# EasyEDA Pro project ProProject_Avaota Pi A_2024-03-25.epro, board 点位 (continued)
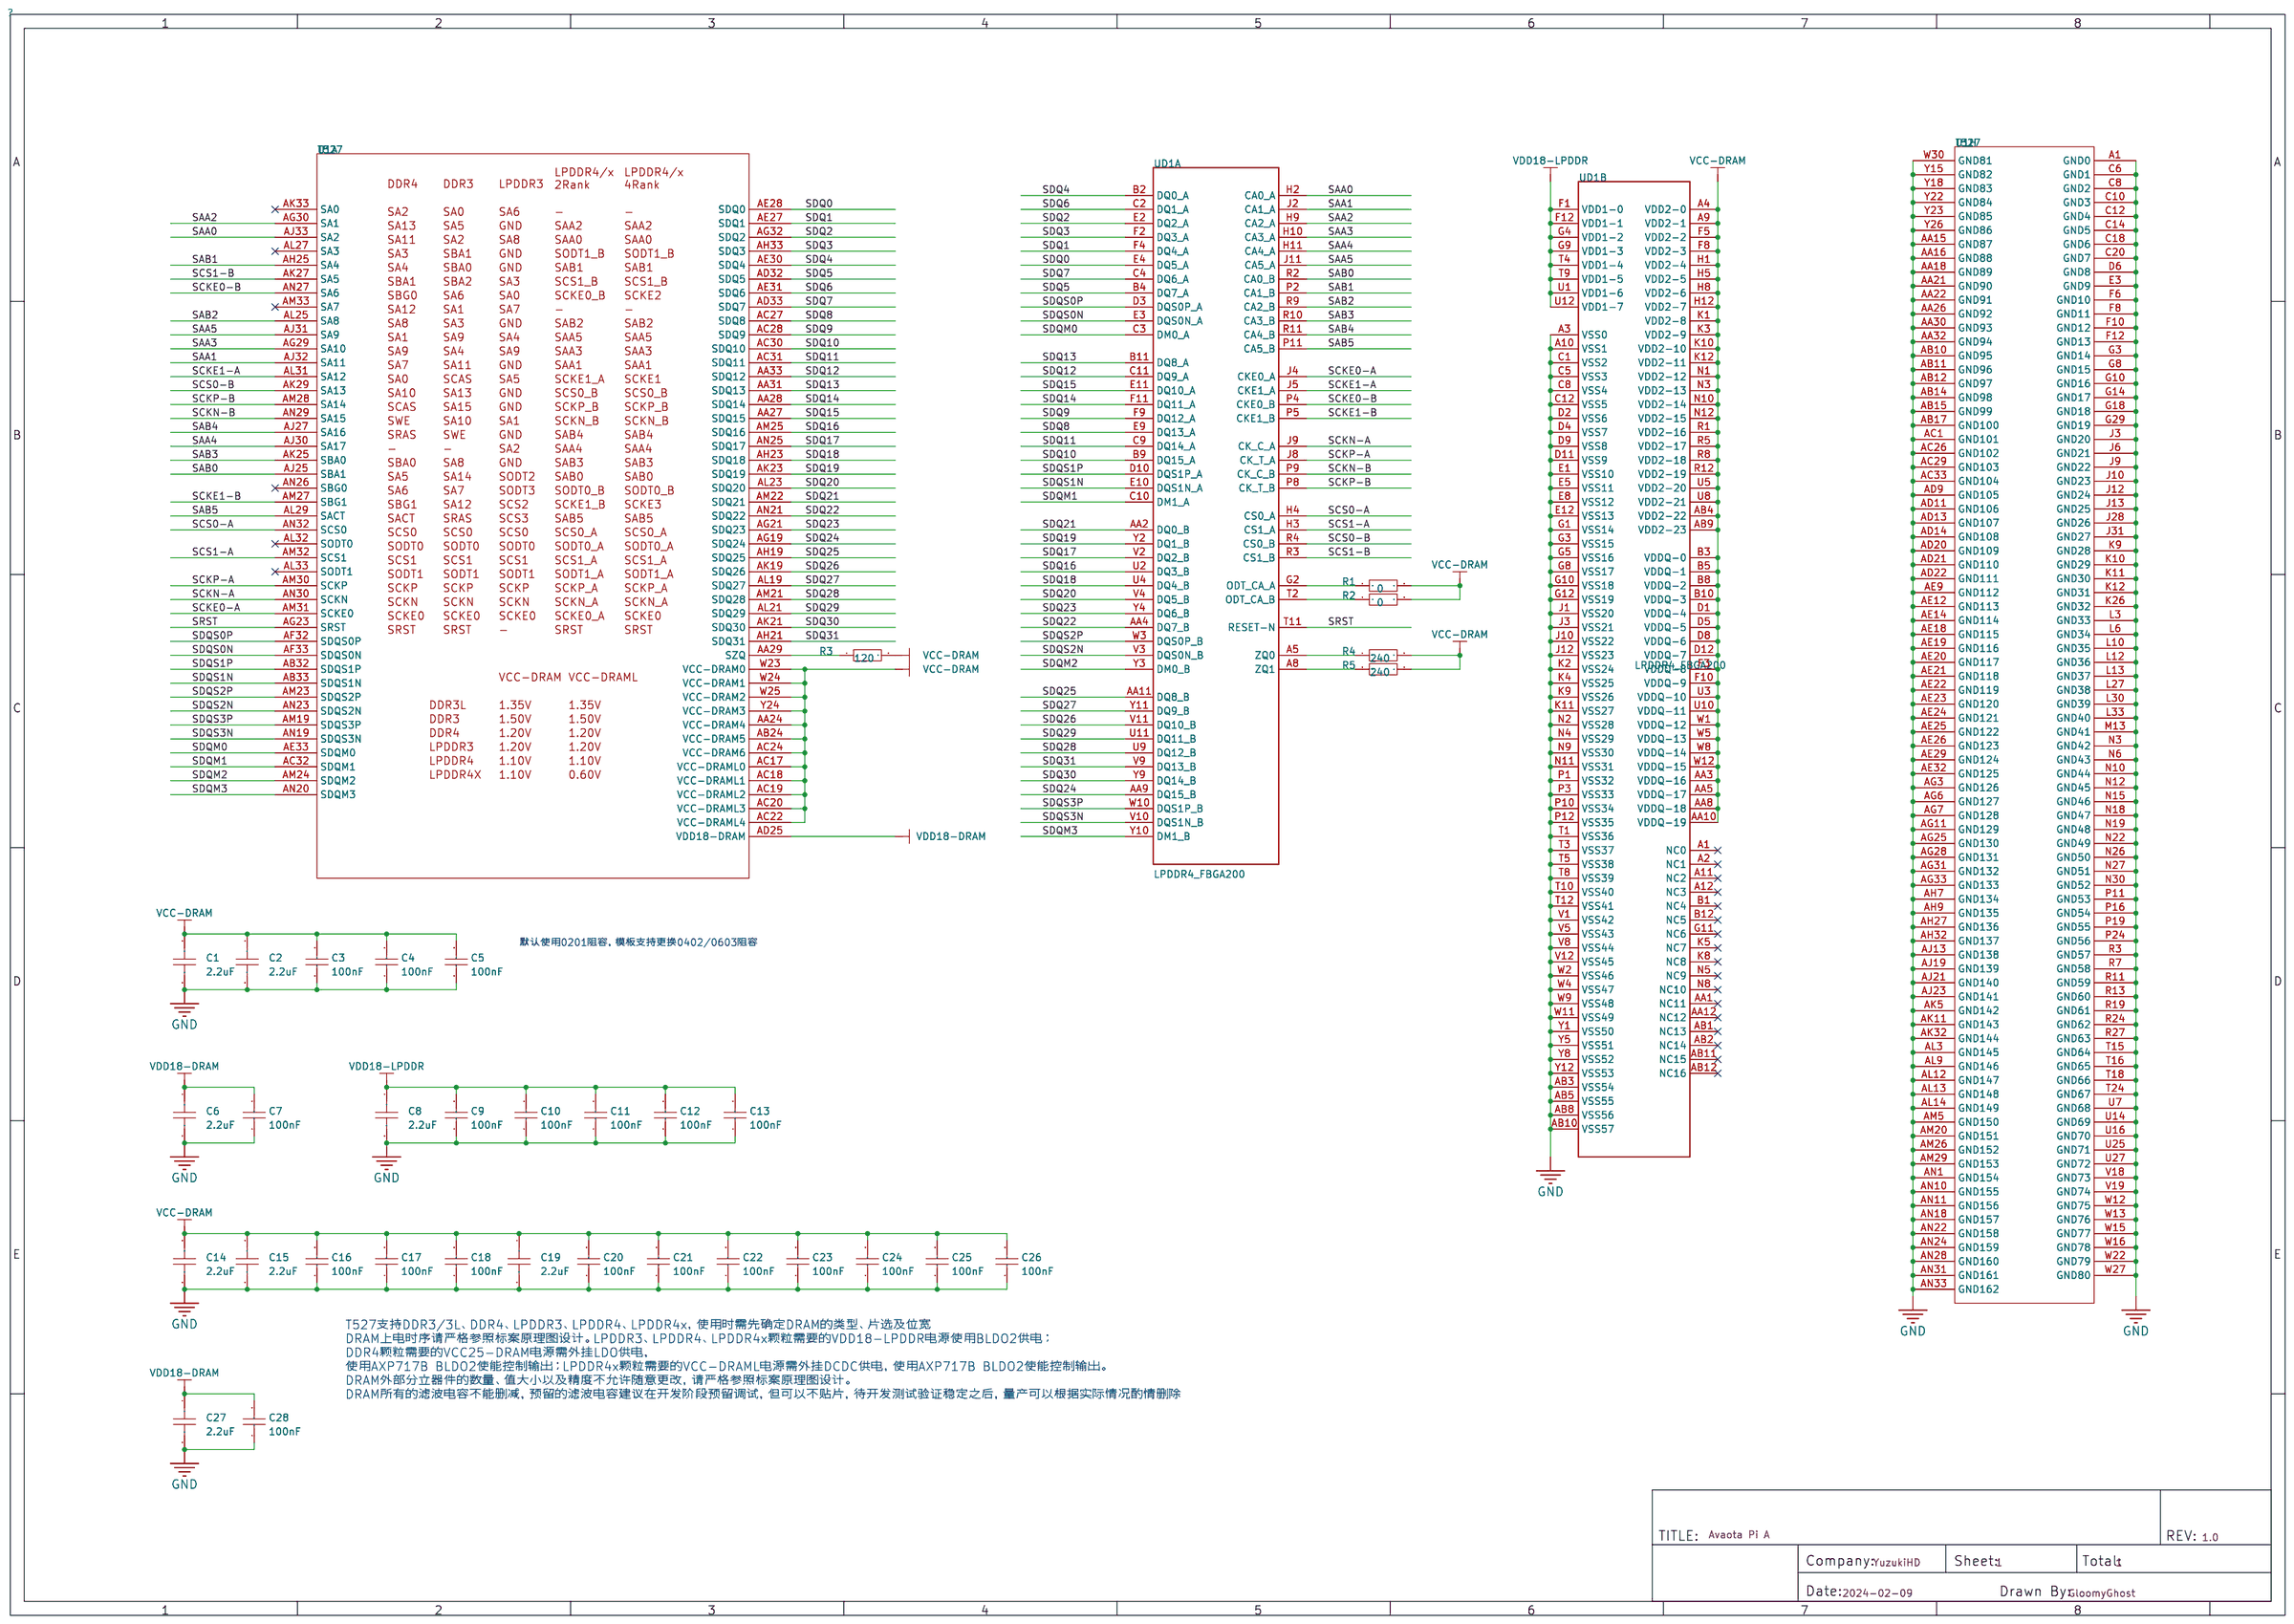
[diagram p0: schematic sheet]
## Routing (per net, layer and track width the routed paths; a pad name or vN(x,y) marks a point on that pad's centre or on a via; arc(x,y) is an arc through that point) (continued)
SDQ24: length 25.9
  Top Layer w0.102: 56.43,47.14 56.43,46.78 v2(56.54,46.68)
  Top Layer w0.115: 35.81,53.3 36.17,53.66 v2(36.17,53.7)
  Inner5 w0.115: v2(36.17,53.7) 36.24,53.77 36.6,53.77 36.88,54.05 36.88,54.46 37.41,54.99 45.37,54.99 49.38,50.99 49.38,50.83 51.51,48.69 54.2,48.69 54.51,48.39 54.51,48.37 55.23,47.65 55.78,47.65 56.54,46.89 v2(56.54,46.68)
SDQ25: length 27.2
  Top Layer w0.115: 56.01,47.07 55.93,47.14 ; v2(37.69,54.61) 37.39,54.91 35.13,54.91 34.57,54.36 34.57,53.66 34.21,53.3 ; 56.01,47.07 v2(56.01,46.68)
  Inner5 w0.115: v2(56.01,46.68) 56.01,46.79 55.52,47.27 55.01,47.27 53.87,48.41 51.13,48.41 48.96,50.58 48.96,50.81 45.68,54.09 40.73,54.09 40.36,54.46 39.04,54.46 38.81,54.23 38.07,54.23 v2(37.69,54.61)
SDQ26: length 27
  Top Layer w0.102: 54.93,47.14 54.93,46.71 v2(54.96,46.68)
  Top Layer w0.115: v2(34.57,51.71) 34.57,51.71 34.21,51.35
  Inner5 w0.115: v2(34.57,51.71) 34.21,52.07 34.21,53.19 34.44,53.42 35.05,53.42 35.18,53.29 36.58,53.29 36.96,53.67 37.79,53.67 38.02,53.9 38.96,53.9 39.09,54.03 40.31,54.03 40.66,53.67 45.39,53.67 48.54,50.52 48.54,50.41 50.84,48.11 53.59,48.11 54.96,46.73 v2(54.96,46.68)
SDQ27: length 24.4
  Top Layer w0.115: v2(34.59,53.01) 34.57,53.01 34.21,52.65 ; 54.43,47.14 v2(54.43,46.68)
  Inner5 w0.115: v2(54.43,46.68) 53.77,47.35 51.01,47.35 46.95,51.41 46.56,51.41 46.3,51.66 46.3,51.79 46,52.1 45.62,52.1 44.49,53.23 41.95,53.23 41.81,53.37 40.46,53.37 40.1,53.72 39.22,53.72 39.11,53.62 38.07,53.62 37.82,53.37 37.54,53.37 37.41,53.24 37.41,52.98 37.26,52.83 34.77,52.83 v2(34.59,53.01)
SDQ28: length 21.8
  Top Layer w0.076: 53.93,46.14 53.68,46.39 53.32,46.39 53.11,46.18 51.69,46.18 51.53,46.33 51.16,46.33
  Top Layer w0.115: 51.16,46.33 50.37,46.33 50.09,46.05 49.3,46.05 49.15,45.9 48.33,45.9 47.27,46.96 v2(47.27,47.2) ; v2(37.64,50.75) 37.03,50.75 36.75,51.03 36.29,51.03 35.97,50.7 35.81,50.7
  Inner5 w0.115: v2(37.64,50.75) 37.64,50.41 37.75,50.29 38.83,50.29 39.16,49.96 39.62,49.96 39.88,50.22 40.49,50.22 40.69,50.01 41.48,50.01 41.55,49.94 42.03,49.94 42.54,49.43 43.12,49.43 43.47,49.07 43.86,49.07 44.09,49.3 44.39,49.3 44.99,48.7 46.09,48.7 46.63,48.16 46.63,47.82 47.26,47.2 v2(47.27,47.2)
SDQ29: length 25
  Top Layer w0.115: 34.21,50.7 34.06,50.7 v2(33.8,50.95) ; 54.43,46.14 v2(54.43,45.68)
  Inner5 w0.115: v2(33.8,50.95) 34.19,50.57 34.19,49.44 34.3,49.33 36.5,49.33 36.68,49.5 38.81,49.5 39.04,49.73 39.78,49.73 40,49.96 40.36,49.96 40.59,49.73 41.25,49.73 41.43,49.56 41.91,49.56 42.45,49.01 42.95,49.01 43.3,48.65 43.93,48.65 44.3,48.29 45.57,48.29 47.14,46.71 47.78,46.71 48.19,46.29 52.18,46.29 52.59,45.88 53.76,45.88 53.96,45.68 v2(54.43,45.68)
SDQ30: length 23.2
  Top Layer w0.102: v2(54.96,45.68) 54.93,45.71 54.93,46.14 ; v2(38.48,52.55) 38.45,52.58 37.72,52.58 37.36,52.93 36.96,52.86 36.78,52.93 36.4,52.93 36.22,52.76 35.91,52.76 35.81,52.65
  Inner5 w0.115: v2(38.48,52.55) 38.96,52.55 39.04,52.48 40.23,52.48 40.49,52.73 41.22,52.73 41.4,52.55 41.4,52.22 41.65,51.97 44.29,51.97 45.81,50.44 46.72,50.44 50.51,46.66 52.25,46.66 52.65,46.25 53.74,46.25 53.95,46.05 54.59,46.05 v2(54.96,45.68)
SDQ31: length 24.9
  Top Layer w0.115: v2(37.79,52.2) 37.79,52.17 37.31,51.68 36.47,51.68 36.13,51.35 35.81,51.35 ; v2(56.01,45.68) 56.01,46.07
  Inner5 w0.115: v2(56.01,45.68) 56.01,45.77 55.5,46.28 54.23,46.28 53.49,47.02 50.75,47.02 46.81,50.95 45.89,50.95 44.04,52.81 41.78,52.81 41.53,53.06 40.18,53.06 39.85,53.39 39.29,53.39 39.01,53.11 39.01,53.02 38.9,52.91 38.28,52.91 37.79,52.43 v2(37.79,52.2)
SDQM0: length 19.5
  Top Layer w0.076: v2(56.61,39) 57.35,39.74 57.39,39.97 57.43,40.15
  Top Layer w0.115: 40.61,41.6 40.89,41.31 v2(40.89,41.27)
  内层2 w0.115: v2(56.61,39) 56.6,39 56.6,38.95 55.87,38.22 43.49,38.22 41.68,40.03 41.68,40.41 40.89,41.2 v2(40.89,41.27)
SDQM1: length 26.3
  Top Layer w0.115: 58.43,40.64 58.43,40.65 v2(57.94,41.15) ; v2(37.89,41.94) 37.77,41.81 37.01,41.81 36.9,41.91 35.63,41.91 35.32,41.6 35.01,41.6
  Inner5 w0.115: v2(37.89,41.94) 37.74,42.09 37.74,42.32 38.05,42.62 39.65,42.62 40.13,42.14 41.09,42.14 42.06,41.17 42.44,41.17 42.83,41.56 43.98,41.56 44.35,41.94 46.15,41.94 46.9,41.19 51.55,41.19 52.19,40.54 57.33,40.54 v2(57.94,41.15)
SDQM2: length 19.9
  Top Layer w0.076: 53.93,44.64 53.68,44.39 53.02,44.39 52.78,44.14 51.79,44.14
  Top Layer w0.115: v2(44.14,51.54) 44.14,52.7 43.46,53.39 42.62,53.39 42.39,53.62 42.13,53.62 41.78,53.28 41.78,53.21 41.53,52.96 41.02,52.96 40.71,52.65 40.61,52.65 ; v2(48.54,45.47) 48.54,45.18 49.75,43.97 51.46,43.97 51.64,44.14 51.79,44.14
  内层2 w0.115: v2(44.14,51.54) 44.12,51.51 44.12,50.75 44.17,50.7 44.17,50.69 46.89,47.97 46.89,47.05 47.63,46.3 47.7,46.3 v2(48.54,45.47)
SDQM3: length 23.5
  Top Layer w0.076: 53.43,46.64 53.33,46.64 53.06,46.38 51.77,46.38 51.53,46.62
  Top Layer w0.115: 51.53,46.62 50.25,46.62 49.91,46.28 49.07,46.28 48.99,46.2 48.44,46.2 47.75,46.89 47.75,47.4 47.37,47.78 v2(47.27,47.78) ; v2(34.62,52.32) 34.94,52.65 35.01,52.65
  Inner5 w0.115: v2(34.62,52.32) 35,51.94 35,51.49 35.66,50.83 37.16,50.83 37.44,51.1 38.43,51.1 38.81,50.72 39.62,50.72 39.77,50.57 40.49,50.57 40.66,50.75 41.96,50.75 42.31,50.39 42.31,50.19 42.65,49.85 44.43,49.85 45.16,49.12 46.17,49.12 47.01,48.29 47.01,48.03 v2(47.27,47.78)
SDQS0N: length 19.7
  Top Layer w0.076: 56.93,40.14 56.89,40.1 56.89,39.94 56.6,39.65 56.42,39.65 56.14,39.37 55.67,39.37 55.54,39.23 v2(55.54,39.03)
  Top Layer w0.097: v2(40.93,42.57) 40.61,42.9
  内层2 w0.127: v2(40.93,42.57) 40.75,42.57 40.63,42.45 40.63,42.18 40.8,42 41.22,42 42.53,40.68 42.53,40.43 43.23,39.73 48.33,39.73 48.54,39.52 52.09,39.52 52.26,39.69 55.03,39.69 55.54,39.18 v2(55.54,39.03)
SDQS0P: length 20.1
  Top Layer w0.076: v2(54.98,39.03) 55.5,39.55 56.06,39.55 56.34,39.83 56.49,39.83 56.69,40.03 56.69,40.26 56.93,40.5 56.93,40.64
  Top Layer w0.127: v2(40.26,42.57) 40.58,42.25 40.61,42.25
  内层2 w0.127: v2(54.98,39.03) 54.61,39.4 52.38,39.4 52.21,39.23 48.42,39.23 48.21,39.44 43.11,39.44 42.24,40.31 42.24,40.56 41.1,41.71 40.68,41.71 40.33,42.06 40.33,42.5 v2(40.26,42.57)
SDQS1N: length 30.2
  Top Layer w0.076: v2(59.23,38.96) 58.93,39.26 58.93,40.14
  Top Layer w0.127: 35.01,42.9 35.01,42.88 v2(34.69,42.57)
  Inner5 w0.127: v2(34.69,42.57) 34.69,42.57 34.8,42.47 34.8,42.19 35.01,41.97 35.01,39.46 36.17,38.3 58.88,38.3 59.18,38.59 59.18,38.91 v2(59.23,38.96)
SDQS1P: length 30.3
  Top Layer w0.076: 58.68,39.72 58.61,39.64 58.47,39.64 58.37,39.54 58.37,39.43 58.47,39.34 58.61,39.34 58.68,39.26 58.68,39.1 58.67,39.09 v2(58.67,38.96) ; 58.69,39.72 58.69,40.05 58.68,40.39 58.93,40.64
  Top Layer w0.127: v2(35.33,42.57) 35.01,42.25
  Inner5 w0.127: v2(35.33,42.57) 35.22,42.57 35.09,42.44 35.09,42.31 35.3,42.09 35.3,39.58 36.29,38.59 58.76,38.59 58.89,38.72 58.89,38.84 58.76,38.96 v2(58.67,38.96)
SDQS2N: length 18.8
  Top Layer w0.076: 53.43,45.14 53.43,45.03 53.36,44.95 53.25,44.95 53.17,45.03 53.17,45.11 53.1,45.19 52.78,45.19 52.2,44.6 50.53,44.6
  Top Layer w0.127: 40.61,51.35 40.99,51.74 v2(40.99,51.76) ; 50.53,44.6 50.26,44.6 49.93,44.93 49.93,45.29 49.76,45.47 v2(49.66,45.47)
  内层2 w0.127: v2(40.99,51.76) 40.99,51.83 41.12,51.96 41.28,51.96 41.49,51.74 43.53,51.74 43.9,52.11 44.36,52.11 44.63,51.83 44.63,50.95 47.69,47.89 47.69,47.03 48.79,45.92 49.72,45.92 49.9,45.74 49.9,45.61 49.76,45.47 v2(49.66,45.47)
SDQS2P: length 18.8
  Top Layer w0.076: 50.59,44.91 50.69,44.91 50.8,44.81 52.11,44.81 52.7,45.39 53.68,45.39 53.93,45.14
  Top Layer w0.127: v2(40.99,52.35) 40.98,52.34 40.95,52.34 40.61,52 ; v2(50.24,45.47) 50.19,45.41 50.19,45.03 50.32,44.91 50.58,44.91 50.59,44.91
  内层2 w0.127: v2(40.99,52.35) 41.09,52.25 41.4,52.25 41.62,52.03 43.41,52.03 43.78,52.4 44.48,52.4 44.92,51.96 44.92,51.07 47.98,48.01 47.98,47.15 48.91,46.21 49.84,46.21 50.19,45.87 50.19,45.52 v2(50.24,45.47)
SDQS3N: length 22.2
  Top Layer w0.076: 53.43,47.14 52.5,47.14 52.42,47.07 52.42,46.89 52.35,46.82 52.2,46.82 52.12,46.89 52.12,47.07 52.04,47.14 51.57,47.14
  Top Layer w0.127: v2(48.75,46.9) 48.99,47.14 51.57,47.14 ; 35.01,51.35 35.01,51.35 v2(35.35,51.69)
  Inner5 w0.127: v2(48.75,46.9) 48.73,46.9 48.58,47.05 48.14,47.05 47.65,47.55 47.65,48.4 46.41,49.63 45.41,49.63 44.4,50.65 42.47,50.65 42.01,51.1 40.56,51.1 39.8,51.87 38.38,51.87 38.05,51.54 37.38,51.54 37.22,51.7 35.92,51.7 35.68,51.94 35.48,51.94 35.35,51.82 v2(35.35,51.69)
SDQS3P: length 22.1
  Top Layer w0.076: 53.93,47.14 53.82,47.14 53.57,47.39 53.2,47.39 53.15,47.35 51.72,47.35 51.67,47.4 51.57,47.4
  Top Layer w0.127: v2(48.74,47.41) 48.76,47.4 51.57,47.4 ; 35.01,52 35.03,52 v2(35.41,52.37)
  Inner5 w0.127: v2(48.74,47.41) 48.67,47.35 48.26,47.35 47.94,47.67 47.94,48.52 46.54,49.92 45.53,49.92 44.52,50.94 42.56,50.94 42.1,51.4 40.68,51.4 39.92,52.16 38.26,52.16 37.93,51.83 37.5,51.83 37.34,51.99 36.04,51.99 35.8,52.23 35.55,52.23 v2(35.41,52.37)
SPI0-CLK: length 19.1
  Top Layer w0.102: R123.1 65.23,59.6 65.23,64.01 64.82,64.41 64.82,65.02 64.26,65.58 61.32,65.58 arc(61.18,65.64) 61.13,65.77 61.13,66.08 arc(60.94,66.27) 60.75,66.08 60.75,65.77 arc(60.56,65.58) 60.36,65.77 60.36,66.08 arc(60.17,66.27) 59.98,66.08 59.98,65.77 arc(59.79,65.58) 59.6,65.77 59.6,66.08 arc(59.41,66.27) 59.22,66.08 59.22,65.77 arc(59.17,65.64) 59.03,65.58 58.95,65.58 58.75,65.38 58.27,65.38 57.89,65 57.89,63.98 v3(58.42,63.45)
  Bottom Layer w0.102: 57.49,63.73 58.14,63.73 v3(58.42,63.45)
SPI0-CS: length 20.7
  Top Layer w0.076: 65.68,58.9 65.68,58.77 65.53,58.62 65.53,57.22 65.2,56.88 65.2,55.4 64.94,55.14
  Top Layer w0.102: 65.68,58.9 65.68,59.69 65.48,59.89 65.48,64.31 65.13,64.67 65.13,65.33 64.49,65.96 63.37,65.96 63.09,66.24 61.85,66.24 61.72,66.37 61.72,66.7 61.85,66.83 63.25,66.83 v3(63.68,66.4)
  Bottom Layer w0.102: 65.42,66.4 65.55,66.27 ; 65.42,66.4 v3(63.68,66.4) ; 65.42,66.4 65.09,66.73 R73.1
SPI0-HOLD: length 15.9
  Top Layer w0.076: 63.44,55.64 63.88,56.08 63.88,58.09 64.24,58.45 64.24,58.99
  Top Layer w0.102: v3(58.62,64.59) 60.02,63.2 63.3,63.2 64.24,62.26 64.24,58.99
  Bottom Layer w0.102: v3(58.62,64.59) 58.22,65 57.49,65 57.47,65.01 R75.1
SPI0-MISO: length 16.7
  Top Layer w0.076: 64.44,56.15 64.34,56.25 64.34,57.73 64.72,58.11 ; 64.72,58.11 64.72,58.8
  Top Layer w0.102: 64.72,58.8 64.72,62.66 63.37,64.01 63.37,64.36 63.47,64.47 v3(63.73,64.47)
  Bottom Layer w0.102: v3(63.73,64.47) 63.7,64.47 63.47,64.69 63.47,65.79 63.6,65.91 63.75,65.91 63.88,65.79 63.88,64.82 63.96,64.74 64.1,64.74 64.19,64.82 64.19,65.79 64.28,65.88 64.4,65.88 64.49,65.79 64.49,64.77 64.8,64.47 65.46,64.47 65.55,64.56 65.55,65
SPI0-MOSI: length 20.7
  Top Layer w0.076: 64.96,58.85 64.96,58.03 64.54,57.61 64.54,56.39 64.7,56.24 64.7,56.05 64.44,55.79 64.44,55.65
  Top Layer w0.102: 64.96,58.85 64.96,63.72 64.47,64.21 64.47,64.82 64.03,65.25 63.17,65.25 62.26,64.34 60.5,64.34 59.77,65.08 58.37,65.08 58.17,64.87 58.17,64.21 58.88,63.5 v3(58.88,63.07)
  Bottom Layer w0.102: v3(58.88,63.07) 58.27,62.46 57.49,62.46
SPI0-WP: length 19.5
  Top Layer w0.076: 64.47,58.98 64.47,58.37 64.1,57.99 64.1,55.8 63.94,55.64
  Top Layer w0.102: 64.47,58.98 64.47,62.48 63.04,63.91 63.04,64.57 63.35,64.87 63.83,64.87 64.08,64.62 64.08,63.91 v3(64.24,63.75)
  Bottom Layer w0.102: v3(64.24,63.75) 63.93,63.75 63.55,63.37 63.55,62.18 63.68,62.05 63.88,62.05 63.98,62.16 63.98,63.17 64.11,63.3 64.31,63.3 64.54,63.07 65.71,63.07 65.86,63.22 65.86,63.42 65.55,63.73 66.74,63.73 R74.1
SPI-LCD-BLK: length 92.5
  Top Layer w0.102: v1(52.45,52.78) 52.81,52.78 U14.AN9
  内层2 w0.127: v1(92.91,54.1) 92.91,60.3 89.56,63.65 64.87,63.65 64.59,63.37 63.2,63.37 62.13,62.31 58.29,62.31 53.39,67.21 49.05,67.21 47.19,65.35 47.19,64.54 46.91,64.26 v1(46.76,64.26)
  Bottom Layer w0.102: H1.32 46.18,73.23 47.24,72.16 47.24,69.85 46.76,69.37 v1(46.76,64.26) 46.76,61.34 47.8,60.3 47.8,59.51 48.92,58.39 48.92,56.79 50.55,55.17 50.55,54.58 52.35,52.78 v1(52.45,52.78)
  Bottom Layer w0.127: v1(92.91,54.1) 87.88,54.1 86.82,53.04 U16.4
SPI-LCD-CLK: length 95.8
  Top Layer w0.102: v3(54.94,52.65) 54.94,52.65 U14.AJ9
  Top Layer w0.127: v1(92.07,45.72) 92.91,44.89 TFT1.4
  内层2 w0.127: v1(47.75,63.47) 47.98,63.7 47.98,64.8 49.66,66.47 52.88,66.47 57.78,61.57 62.74,61.57 63.78,62.61 65.1,62.61 65.41,62.92 89.08,62.92 92,60 92,53.65 92.53,53.11 92.53,49.94 91.41,48.82 91.41,48.29 92.05,47.65 92.05,45.75 v1(92.07,45.72)
  Bottom Layer w0.102: v3(54.94,52.65) 54.53,53.06 54.25,53.06 54.18,52.98 53.26,52.98 52.68,53.57 52.53,53.57 51.18,54.92 51.18,55.52 49.58,57.12 49.58,58.67 48.41,59.84 48.41,60.78 47.75,61.44 v1(47.75,63.47) 47.75,68.71 48.34,69.29 48.92,69.29 49.89,70.26 49.89,71.88 51.08,73.08 H1.36
SPI-LCD-CS: length 93.9
  Top Layer w0.102: U14.AK9 v3(54.43,52.65)
  Top Layer w0.127: v1(90.91,45.29) 90.81,45.19 TFT1.7
  内层2 w0.127: v1(90.91,45.29) 91.14,45.52 91.57,45.52 91.9,45.19 92.18,45.19 92.46,45.47 92.46,49.17 92.91,49.63 92.91,53.29 92.46,53.75 92.46,60.17 89.36,63.27 65.13,63.27 64.85,62.99 63.45,62.99 62.38,61.93 58.01,61.93 53.14,66.8 49.4,66.8 47.57,64.97 47.57,64.11 47.32,63.86 v1(47.24,63.86)
  Bottom Layer w0.102: v3(54.43,52.65) 53.16,52.65 52.65,53.16 52.48,53.16 50.88,54.76 50.88,55.37 49.25,57 49.25,58.52 48.11,59.66 48.11,60.53 47.24,61.39 v1(47.24,63.86) 47.24,69.06 48.54,70.36 48.54,70.69
SPI-LCD-DC: length 94.1
  Top Layer w0.102: v3(54.97,53.62) U14.AJ7
  Top Layer w0.127: TFT1.5 92.2,44.9 91.57,45.54 v1(91.57,46.18)
  内层2 w0.127: v1(91.57,46.18) 91.57,46.48 90.58,47.47 90.58,49.33 91.77,50.52 91.77,52.48 91.03,53.21 91.03,59.77 88.62,62.18 65.81,62.18 65.46,61.82 64.29,61.82 63.32,60.86 57.51,60.86 52.58,65.79 50.09,65.79 48.72,64.41 v1(48.72,62.69)
  Bottom Layer w0.076: v3(54.97,53.62) 54.64,53.95 54.28,53.95 54,53.67 53.52,53.67
  Bottom Layer w0.102: 53.52,53.67 51.82,55.37 51.82,55.93 50.29,57.46 50.29,58.9 49.05,60.15 49.05,61.21 48.72,61.54 v1(48.72,62.69) 48.72,68.07 49,68.35 49.48,68.35 50.52,69.39 51.84,69.39 52.43,69.98 52.43,72.06 52.88,72.52 52.91,72.52 H1.38
SPI-LCD-MOSI: length 91.5
  Top Layer w0.102: v3(54.46,53.62) 54.47,53.62 U14.AK7
  Top Layer w0.127: TFT1.3 93.6,45.1 v1(91.62,47.09)
  内层2 w0.127: v1(48.21,63.07) 48.34,63.2 48.34,64.57 49.89,66.12 52.73,66.12 57.66,61.19 63.04,61.19 64.11,62.26 65.3,62.26 65.61,62.56 88.85,62.56 91.49,59.92 91.49,53.47 92.18,52.78 92.18,50.27 91.01,49.1 91.01,47.7 v1(91.62,47.09)
  Bottom Layer w0.102: 51.08,70.69 51.05,70.69 49.23,68.86 48.64,68.86 48.21,68.43 v1(48.21,63.07) 48.21,61.57 48.72,61.06 48.72,60.02 49.94,58.8 49.94,57.28 51.49,55.73 51.49,55.12 52.65,53.95 52.81,53.95 53.49,53.26 54.1,53.26 v3(54.46,53.62)
SPI-LCD-RST: length 95
  Top Layer w0.076: v3(52.45,52.25) 52.96,52.25 53.31,51.89 53.69,51.89 U14.AM9
  Top Layer w0.127: v1(91.52,44.86) 91.52,42.37 TFT1.6
  内层2 w0.127: v1(91.52,44.86) 91.67,44.7 92.35,44.7 92.86,45.21 92.86,47.24 93.37,47.75 93.37,60.4 89.71,64.06 64.77,64.06 64.67,64.16 64.06,64.16 63.75,63.86 62.99,63.86 61.77,62.64 58.55,62.64 53.59,67.59 48.89,67.59 46.35,65.05 v1(46.35,64.74)
  Bottom Layer w0.102: v3(52.45,52.25) 50.24,54.46 50.24,55.09 48.62,56.72 48.62,58.29 47.55,59.36 47.55,60.05 46.35,61.24 v1(46.35,64.74) 46.35,70.33 46,70.69
SRST: length 27.9
  Top Layer w0.076: v2(56.56,44.66) 56.54,44.68 56.54,44.76 56.43,44.87 56.43,45.14
  Top Layer w0.102: v2(34.63,50.27) 34.62,50.25 34.61,50.25 34.59,50.24 34.4,50.24 34.21,50.05
  内层2 w0.115: v2(56.56,44.66) 56.22,44.32 52.7,44.32 52.17,44.86 47.22,44.86 45.97,46.1 45.54,46.1 45.31,46.33 45.31,46.74 45.59,47.02 45.59,47.49 44.77,48.31 44.22,48.31 42.24,50.29 42.24,50.52 41.93,50.83 40.71,50.83 40.46,50.57 40,50.57 39.85,50.72 38.89,50.72 38.45,50.29 37.36,50.29 36.75,50.9 35.27,50.9 v2(34.63,50.27)
STWI1-SCK: length 27.6
  Top Layer w0.076: 53.92,54.63 53.69,54.4 52.54,54.4 51.99,54.94 51.99,55.85 51.26,56.59
  Top Layer w0.102: v1(46.86,57.48) 47.17,57.18 50.67,57.18 51.26,56.59
  Bottom Layer w0.102: 41.92,72.21 41.92,72.23 H1.28 ; 41.92,72.21 42.24,71.88 42.24,70.13 43.18,69.19 43.18,67.06 45.54,64.69 45.54,60.88 46.76,59.66 46.76,57.58 v1(46.86,57.48) ; 41.92,72.21 41.63,72.49
STWI1-SDA: length 22.9
  Top Layer w0.076: 53.69,54.89 52.7,54.89
  Top Layer w0.102: U14.AM3 53.69,54.89 ; 52.7,54.89 52.32,55.27 52.32,56.06 50.9,57.48 47.68,57.48 v1(47.32,57.84)
  Bottom Layer w0.102: 43.46,70.69 43.51,70.64 43.51,67.16 45.9,64.77 45.9,61.06 47.19,59.77 47.19,57.96 v1(47.32,57.84)
UART1-CTS: length 54.7
  Top Layer w0.076: U9.41 19.74,66.04 19.43,65.74 19.43,61.44 v3(19.66,61.21)
  Top Layer w0.102: v3(61.95,53.65) U14.U6
  Inner5 w0.102: v3(19.66,61.21) 21.84,63.4 45.26,63.4 49.2,59.46 55.25,59.46 56.59,58.12 58.17,58.12 61.04,55.25 62.2,55.25 62.56,54.89 62.56,54.26 v3(61.95,53.65)
UART1-RTS: length 57.3
  Top Layer w0.076: v3(19.05,61.24) 18.75,60.93 17.73,60.93 17.51,61.16 17.51,61.45 18.34,62.28 18.34,64.95 17.7,65.58 17.5,65.58 17.04,66.04 U9.44
  Top Layer w0.102: v3(62.95,54.65) U14.R4
  Inner5 w0.102: v3(62.95,54.65) 62.95,54.93 62.36,55.52 61.19,55.52 58.32,58.39 56.69,58.39 55.32,59.77 49.3,59.77 45.34,63.73 21.54,63.73 v3(19.05,61.24)
UART1-RX: length 56.7
  Top Layer w0.076: v3(18.49,61.29) 19.05,61.85 19.05,66.16 U9.42
  Top Layer w0.102: v3(62.95,54.15) U14.R5
  Inner5 w0.102: v3(62.95,54.15) 63.3,54.49 63.3,55.09 62.59,55.8 61.32,55.8 58.45,58.67 56.82,58.67 55.35,60.15 49.35,60.15 45.44,64.06 21.26,64.06 v3(18.49,61.29)
UART1-TX: length 58.8
  Top Layer w0.076: v3(17.91,61.32) 18.72,62.13 18.72,65.08 17.94,65.86 U9.43
  Top Layer w0.102: U14.R6 v3(62.95,53.65)
  Inner5 w0.102: v3(17.91,61.32) 20.98,64.39 45.54,64.39 49.5,60.43 55.52,60.43 57.02,58.93 58.6,58.93 61.42,56.11 62.71,56.11 63.6,55.22 63.6,54.3 v3(62.95,53.65)
USB0-DM: length 37.7
  Top Layer w0.076: U14.B24 69.05,44.65 69.29,44.4 70.72,44.4 70.82,44.5 71.37,44.5 71.45,44.58 75.11,44.58 v3(75.23,44.45)
  Top Layer w0.127: USB3.A7 85.47,68.48 85.47,67.62 v3(85.34,67.49) 85.34,67.11 85.1,66.86 D26.2 85.55,66.28 85.55,65.2 v3(85.37,65.02) ; USB3.B7 86.4,67.58 v3(86.33,67.51)
  VCC w0.127: v3(75.23,44.45) 75.23,44.79 75.37,44.93 75.37,46.84 81.36,52.83 81.36,59.44 85.55,63.63 85.55,64.85 v3(85.37,65.02)
  Bottom Layer w0.127: v3(86.33,67.51) 86.31,67.49 v3(85.34,67.49)
USB0-DP: length 38.1
  Top Layer w0.076: v3(75.74,44.53) 75.43,44.84 71.33,44.84 71.17,44.68 70.69,44.68 70.61,44.6 69.7,44.6 69.66,44.65 U14.A24
  Top Layer w0.127: v3(85.95,65.02) 85.78,65.2 85.78,66.41 D25.2 85.83,67.27 85.83,68.48 USB3.A6 85.9,69.35 85.72,69.52 85.09,69.52 84.9,69.33 USB3.B6
  VCC w0.127: v3(75.74,44.53) 75.74,44.79 75.6,44.93 75.6,46.7 81.64,52.73 81.64,59.36 85.78,63.5 85.78,64.85 v3(85.95,65.02)
USB0-DRVVBUS: length 90
  Top Layer w0.076: 56.92,47.11 v1(56.92,46.99) 56.87,47.22 56.67,47.32 56.46,47.57 55.01,47.57 U14.AL17
  Top Layer w0.152: R118.2 94.72,64.52 U17.4 93.48,64.96 v1(93.32,65.13)
  内层2 w0.102: v1(56.92,46.99) 55.98,47.93 54.74,47.93 54.41,48.26 53.9,48.26 52.12,50.04 51.31,50.04 50.9,50.44 50.9,53.95 49.3,55.55 46.53,55.55 45.62,56.46 45.01,56.46 44.63,56.85 44.35,56.85 v1(43.56,57.63)
  内层4 w0.152: v1(42.09,64.9) 44.58,67.39 64.26,67.39 67.01,64.64 87.78,64.64 91.16,68.02 91.64,68.02 91.95,67.72 91.95,66.5 v1(93.32,65.13)
  Bottom Layer w0.102: v1(42.09,64.9) 43,63.98 43,59.11 43.69,58.42 43.69,57.76 v1(43.56,57.63)
USB0-VBUSDET: length 83.1
  Top Layer w0.076: U14.AK17 55.26,47.83 56.67,47.83 v1(56.92,47.57)
  Top Layer w0.102: R121.2 R120.1 91.5,68.22 91.36,68.08 v3(91.36,67.62)
  内层2 w0.102: v1(56.92,47.57) 56.26,48.23 54.86,48.23 54.56,48.54 53.97,48.54 52.22,50.29 51.46,50.29 51.18,50.57 51.18,54.15 49.5,55.83 46.74,55.83 45.72,56.85 45.16,56.85 44.78,57.23 44.63,57.23 v1(44.15,57.71)
  内层4 w0.152: v3(91.36,67.62) 87.99,64.24 66.7,64.24 64.01,66.93 44.7,66.93 v1(42.67,64.9)
  Bottom Layer w0.102: v1(42.67,64.9) 43.31,64.26 43.31,59.26 43.97,58.6 43.97,57.89 v1(44.15,57.71)
USB1-DM: length 99.4
  Top Layer w0.102: v3(67.44,45.15) U14.E24
  Top Layer w0.127: USB2.2 28.65,7.24 28.88,7.01 28.88,6.51 29.57,5.82 32.99,5.82 34.62,7.44 35.55,7.44 37.62,9.51 37.62,12.29 36.29,13.61 33.41,13.61 32.42,14.61 32.42,14.93 32.56,15.07 D13.7 D13.4 32.49,16.42 32.49,17.09 v3(32.54,17.15)
  Bottom Layer w0.127: v3(32.54,17.15) 32.41,17.02 32.41,15.11 31.85,14.55 28.11,14.55 26.71,15.96 26.71,19.82 35.03,28.14 44,28.14 47.02,31.17 66.52,31.17 71.32,35.97 71.32,42.62 69.9,44.04 69.15,44.04 68.39,44.8 67.79,44.8 v3(67.44,45.15)
USB1-DP: length 99.2
  Top Layer w0.102: U14.D24 v3(67.94,45.15)
  Top Layer w0.127: v3(32.03,17.15) 32.11,17.07 32.11,16.4 D13.5 D13.6 32.06,15.07 32.19,14.93 32.19,14.51 33.32,13.39 36.2,13.39 37.39,12.19 37.39,9.6 35.46,7.67 34.53,7.67 32.9,6.05 29.67,6.05 29.11,6.6 29.11,7.01 29.33,7.24 USB2.3
  Bottom Layer w0.127: v3(32.03,17.15) 32.18,16.99 32.18,16.87 32.06,16.74 31.79,16.74 31.66,16.62 31.66,16.49 31.79,16.36 32.06,16.36 32.18,16.24 32.18,16.11 32.06,15.98 31.79,15.98 31.66,15.86 31.66,15.73 31.79,15.6 32.06,15.6 32.18,15.47 32.18,15.24 31.75,14.81 28.18,14.81 26.94,16.05 26.94,19.72 35.13,27.91 44.09,27.91 47.14,30.96 66.64,30.96 71.53,35.85 71.53,42.71 69.96,44.27 69.24,44.27 68.49,45.03 68.33,45.03 68.21,45.15 v3(67.94,45.15)
USB2-DM: length 94.3
  Top Layer w0.102: U14.E22 v3(67.44,46.15)
  Top Layer w0.127: v3(24.41,14.2) 24.26,14.35 24.26,14.95 24.39,15.08 D14.7 D14.4 24.39,16.68 24.26,16.82 24.26,18.34 25.3,19.38 27.53,19.38 27.86,19.05 27.86,18.21 v3(27.69,18.03)
  Bottom Layer w0.127: v3(24.41,14.2) 24.41,13.94 24.27,13.8 24.27,13.73 24.84,13.16 25.52,13.16 26.14,12.54 26.14,11.51 26.97,10.68 26.97,10.09 27.32,9.73 28.63,9.73 28.93,10.03 28.93,10.24 28.73,10.44 USB2.11 ; v3(67.44,46.15) 67.79,45.8 68.39,45.8 69.59,44.6 70.13,44.6 71.98,42.75 71.98,39.83 74.02,37.8 74.02,34.93 76.25,32.7 76.25,31.42 75.23,30.4 47.76,30.4 44.38,27.03 35.52,27.03 34.39,25.9 34.21,25.9 34.03,25.72 34.03,25.54 33.85,25.36 33.67,25.36 33.49,25.18 33.49,25 33.31,24.82 33.13,24.82 32.95,24.64 32.95,24.46 32.77,24.28 32.59,24.28 32.41,24.1 32.41,23.92 32.24,23.75 32.06,23.75 31.88,23.57 31.88,23.39 31.7,23.21 31.52,23.21 31.34,23.03 31.34,22.85 31.16,22.67 30.98,22.67 30.8,22.49 30.8,22.31 30.62,22.13 30.44,22.13 30.26,21.95 30.26,21.77 30.08,21.59 29.9,21.59 29.72,21.41 29.72,21.23 29.54,21.05 29.36,21.05 29.18,20.87 29.18,20.69 29,20.51 28.82,20.51 28.64,20.33 28.64,20.15 28.46,19.97 28.28,19.97 28.1,19.79 28.1,19.61 27.86,19.37 27.86,18.21 v3(27.69,18.03)
USB2-DP: length 94.4
  Top Layer w0.102: U14.D22 v3(67.94,46.15)
  Top Layer w0.127: v3(23.9,14.2) 24.03,14.32 24.03,14.95 23.89,15.08 D14.6 23.89,16.7 24.03,16.84 24.03,18.49 25.15,19.61 27.63,19.61 28.09,19.14 28.09,18.29 v3(28.35,18.03)
  Bottom Layer w0.127: USB2.12 29.98,10.49 29.41,10.49 29.16,10.24 29.16,9.94 28.72,9.5 27.23,9.5 26.74,9.99 26.74,10.58 25.91,11.41 25.91,12.45 25.43,12.93 24.75,12.93 24.04,13.64 24.04,13.8 23.9,13.94 v3(23.9,14.2) ; v3(67.94,46.15) 68.21,46.15 68.33,46.03 68.49,46.03 69.69,44.83 70.22,44.83 72.21,42.84 72.21,39.93 74.24,37.9 74.24,35.03 76.48,32.79 76.48,31.33 75.35,30.2 47.88,30.2 44.48,26.8 35.61,26.8 28.09,19.28 28.09,18.29 v3(28.35,18.03)
USB2-RXN: length 84.2
  Top Layer w0.076: U14.C23 68.7,44.89 69.71,44.89 69.82,44.79 70.52,44.79 70.88,45.15 71.69,45.15 71.81,45.26 72.11,45.26 v3(72.31,45.47)
  Top Layer w0.127: USB2.14 32.46,11.94 32.16,12.24 32.16,13.41 31.01,14.55 31.01,14.95 31.15,15.08 D15.10 D15.1 31.15,16.68 31.04,16.79 31.04,17.02 v3(31.17,17.15)
  Bottom Layer w0.127: v3(72.31,45.47) 72.31,45.2 72.26,45.15 72.26,45.09 73.71,43.64 73.71,40.95 74.98,39.68 76.52,39.68 79.5,36.7 79.5,31.55 76.45,28.5 49.19,28.5 45.46,24.77 36.96,24.77 30.99,18.8 30.99,17.32 v3(31.17,17.15)
USB2-RXP: length 84.2
  Top Layer w0.076: U14.B23 69,45.09 69.77,45.09 69.9,44.95 70.38,44.95 70.76,45.34 71.55,45.34 v3(71.83,45.62)
  Top Layer w0.127: USB2.15 31.62,11.94 31.93,12.24 31.93,13.32 30.79,14.46 30.79,14.95 30.65,15.08 D15.9 D15.2 30.65,16.71 30.71,16.76 30.71,17.07 v3(30.63,17.15)
  Bottom Layer w0.127: v3(71.83,45.62) 71.83,45.23 73.48,43.58 73.48,40.85 74.89,39.45 76.43,39.45 79.27,36.6 79.27,31.65 76.35,28.73 49.1,28.73 45.36,24.99 36.86,24.99 30.78,18.92 30.78,18.3 30.66,18.17 30.33,18.17 30.2,18.04 30.2,17.92 30.33,17.79 30.66,17.79 30.78,17.66 30.78,17.3 v3(30.63,17.15)
USB2-TXN: length 76.6
  Top Layer w0.076: v3(71.3,46.05) 71.3,46 70.94,45.64 69.95,45.64 69.73,45.42 arc(69.52,45.32) 69.29,45.36 arc(69.11,45.48) 68.96,45.65
  Top Layer w0.127: v3(29.64,18.29) 29.52,18.16 29.52,18.01 29.65,17.88 C219.1
  Bottom Layer w0.127: v3(71.3,46.05) 71.3,45.76 71.16,45.62 71.16,44.84 72.87,43.13 72.87,40.46 74.57,38.76 76.24,38.76 78.56,36.44 78.56,32.11 75.74,29.29 48.44,29.29 44.81,25.66 36.3,25.66 29.49,18.85 29.49,18.44 v3(29.64,18.29)
USB2-TXP: length 76.6
  Top Layer w0.076: U14.A22 69.67,45.65 69.9,45.87 70.64,45.87 v3(70.79,46.03)
  Top Layer w0.127: C220.1 29.24,17.89 29.24,18.19 v3(29.13,18.29)
  Bottom Layer w0.127: v3(29.13,18.29) 29.26,18.42 29.26,18.95 29.49,19.18 29.49,19.46 29.62,19.59 29.9,19.59 30.03,19.72 30.03,19.99 30.16,20.12 30.44,20.12 30.57,20.25 30.57,20.53 30.7,20.66 30.97,20.66 31.1,20.79 31.1,21.07 31.23,21.2 31.51,21.2 31.64,21.33 31.64,21.61 31.77,21.74 32.05,21.74 32.18,21.87 32.18,22.15 32.31,22.28 32.59,22.28 32.72,22.41 32.72,22.69 32.85,22.82 33.13,22.82 33.26,22.95 33.26,23.23 33.39,23.36 33.67,23.36 36.2,25.89 44.72,25.89 48.37,29.54 75.67,29.54 78.33,32.21 78.33,36.35 76.15,38.53 74.48,38.53 72.64,40.37 72.64,43.03 70.93,44.74 70.93,45.62 70.79,45.76 v3(70.79,46.03)
